# EAGLE board Resistor_Resistor (EAGLE 8.3.0), part 7 of 32
## Placement (x,y rotation side) (continued)
R7867  10K  [0201]  72.9,41.5 0 top
R7868  10K  [0201]  72.9,42.11 0 top
R7869  10K  [0201]  72.9,42.72 0 top
R7870  10K  [0201]  72.9,43.33 0 top
R7871  10K  [0201]  72.9,43.94 0 top
R7872  10K  [0201]  72.9,44.55 0 top
R7873  10K  [0201]  72.9,45.16 0 top
R7874  10K  [0201]  72.9,45.77 0 top
R7875  10K  [0201]  72.9,46.38 0 top
R7876  10K  [0201]  72.9,46.99 0 top
R7877  10K  [0201]  72.9,47.6 0 top
R7878  10K  [0201]  72.9,48.21 0 top
R7879  10K  [0201]  72.9,48.82 0 top
R7880  10K  [0201]  72.9,49.43 0 top
R7881  10K  [0201]  72.9,50.04 0 top
R7882  10K  [0201]  72.9,50.65 0 top
R7883  10K  [0201]  72.9,51.26 0 top
R7884  10K  [0201]  72.9,51.87 0 top
R7885  10K  [0201]  72.9,52.48 0 top
R7886  10K  [0201]  72.9,53.09 0 top
R7887  10K  [0201]  72.9,53.7 0 top
R7888  10K  [0201]  72.9,54.31 0 top
R7889  10K  [0201]  72.9,54.91 0 top
R7890  10K  [0201]  72.9,55.52 0 top
R7891  10K  [0201]  72.9,56.13 0 top
R7892  10K  [0201]  72.9,56.74 0 top
R7893  10K  [0201]  72.9,57.35 0 top
R7894  10K  [0201]  72.9,57.96 0 top
R7895  10K  [0201]  72.9,58.57 0 top
R7896  10K  [0201]  72.9,59.18 0 top
R7897  10K  [0201]  72.9,59.79 0 top
R7898  10K  [0201]  72.9,60.4 0 top
R7899  10K  [0201]  72.9,61.01 0 top
R7900  10K  [0201]  72.9,61.62 0 top
R7901  10K  [0201]  72.9,62.23 0 top
R7902  10K  [0201]  72.9,62.84 0 top
R7903  10K  [0201]  72.9,63.45 0 top
R7904  10K  [0201]  72.9,64.06 0 top
R7905  10K  [0201]  72.9,64.67 0 top
R7906  10K  [0201]  72.9,65.28 0 top
R7907  10K  [0201]  72.9,65.89 0 top
R7908  10K  [0201]  72.9,66.5 0 top
R7909  10K  [0201]  72.9,67.11 0 top
R7910  10K  [0201]  72.9,67.72 0 top
R7911  10K  [0201]  72.9,68.33 0 top
R7912  10K  [0201]  72.9,68.94 0 top
R7913  10K  [0201]  72.9,69.55 0 top
R7914  10K  [0201]  72.9,70.15 0 top
R7915  10K  [0201]  72.9,70.76 0 top
R7916  10K  [0201]  72.9,71.37 0 top
R7917  10K  [0201]  72.9,71.98 0 top
R7918  10K  [0201]  72.9,72.59 0 top
R7919  10K  [0201]  72.9,73.2 0 top
R7920  10K  [0201]  72.9,73.81 0 top
R7921  10K  [0201]  72.9,74.42 0 top
R7922  10K  [0201]  72.9,75.03 0 top
R7923  10K  [0201]  72.9,75.64 0 top
R7924  10K  [0201]  72.9,76.25 0 top
R7925  10K  [0201]  72.9,76.86 0 top
R7926  10K  [0201]  72.9,77.47 0 top
R7927  10K  [0201]  72.9,78.08 0 top
R7928  10K  [0201]  72.9,78.69 0 top
R7929  10K  [0201]  72.9,79.3 0 top
R7930  10K  [0201]  72.9,79.91 0 top
R7931  10K  [0201]  72.9,80.52 0 top
R7932  10K  [0201]  72.9,81.13 0 top
R7933  10K  [0201]  72.9,81.74 0 top
R7934  10K  [0201]  72.9,82.35 0 top
R7935  10K  [0201]  72.9,82.96 0 top
R7936  10K  [0201]  72.9,83.57 0 top
R7937  10K  [0201]  72.9,84.18 0 top
R7938  10K  [0201]  72.9,84.79 0 top
R7939  10K  [0201]  72.9,85.39 0 top
R7940  10K  [0201]  72.9,86 0 top
R7941  10K  [0201]  72.9,86.61 0 top
R7942  10K  [0201]  72.9,87.22 0 top
R7943  10K  [0201]  72.9,87.83 0 top
R7944  10K  [0201]  72.9,88.44 0 top
R7945  10K  [0201]  72.9,89.05 0 top
R7946  10K  [0201]  72.9,89.66 0 top
R7947  10K  [0201]  72.9,90.27 0 top
R7948  10K  [0201]  72.9,90.88 0 top
R7949  10K  [0201]  72.9,91.49 0 top
R7950  10K  [0201]  72.9,92.1 0 top
R7951  10K  [0201]  72.9,92.71 0 top
R7952  10K  [0201]  72.9,93.32 0 top
R7953  10K  [0201]  72.9,93.93 0 top
R7954  10K  [0201]  72.9,94.54 0 top
R7955  10K  [0201]  72.9,95.15 0 top
R7956  10K  [0201]  72.9,95.76 0 top
R7957  10K  [0201]  72.9,96.37 0 top
R7958  10K  [0201]  72.9,96.98 0 top
R7959  10K  [0201]  72.9,97.59 0 top
R7960  10K  [0201]  72.9,98.2 0 top
R7961  10K  [0201]  72.9,98.81 0 top
R7962  10K  [0201]  72.9,99.42 0 top
R7963  10K  [0201]  72.9,100.03 0 top
R7964  10K  [0201]  72.9,100.63 0 top
R7965  10K  [0201]  72.9,101.24 0 top
R7966  10K  [0201]  72.9,101.85 0 top
R7967  10K  [0201]  72.9,102.46 0 top
R7968  10K  [0201]  72.9,103.07 0 top
R7969  10K  [0201]  72.9,103.68 0 top
R7970  10K  [0201]  72.9,104.29 0 top
R7971  10K  [0201]  72.9,104.9 0 top
R7972  10K  [0201]  72.9,105.51 0 top
R7973  10K  [0201]  72.9,106.12 0 top
R7974  10K  [0201]  72.9,106.73 0 top
R7975  10K  [0201]  72.9,107.34 0 top
R7976  10K  [0201]  72.9,107.95 0 top
R7977  10K  [0201]  72.9,108.56 0 top
R7978  10K  [0201]  72.9,109.17 0 top
R7979  10K  [0201]  72.9,109.78 0 top
R7980  10K  [0201]  72.9,110.39 0 top
R7981  10K  [0201]  72.9,111 0 top
R7982  10K  [0201]  72.9,111.61 0 top
R7983  10K  [0201]  72.9,112.22 0 top
R7984  10K  [0201]  72.9,112.83 0 top
R7985  10K  [0201]  72.9,113.44 0 top
R7986  10K  [0201]  72.9,114.05 0 top
R7987  10K  [0201]  72.9,114.66 0 top
R7988  10K  [0201]  72.9,115.27 0 top
R7989  10K  [0201]  72.9,115.87 0 top
R7990  10K  [0201]  72.9,116.48 0 top
R7991  10K  [0201]  72.9,117.09 0 top
R7992  10K  [0201]  72.9,117.7 0 top
R7993  10K  [0201]  72.9,118.31 0 top
R7994  10K  [0201]  72.9,118.92 0 top
R7995  10K  [0201]  72.9,119.53 0 top
R7996  10K  [0201]  72.9,120.14 0 top
R7997  10K  [0201]  72.9,120.75 0 top
R7998  10K  [0201]  72.9,121.36 0 top
R7999  10K  [0201]  72.9,121.97 0 top
R8000  10K  [0201]  72.9,122.58 0 top
R8001  10K  [0201]  74.12,1.27 0 top
R8002  10K  [0201]  74.12,1.88 0 top
R8003  10K  [0201]  74.12,2.49 0 top
R8004  10K  [0201]  74.12,3.1 0 top
R8005  10K  [0201]  74.12,3.71 0 top
R8006  10K  [0201]  74.12,4.32 0 top
R8007  10K  [0201]  74.12,4.93 0 top
R8008  10K  [0201]  74.12,5.54 0 top
R8009  10K  [0201]  74.12,6.15 0 top
R8010  10K  [0201]  74.12,6.76 0 top
R8011  10K  [0201]  74.12,7.37 0 top
R8012  10K  [0201]  74.12,7.98 0 top
R8013  10K  [0201]  74.12,8.59 0 top
R8014  10K  [0201]  74.12,9.19 0 top
R8015  10K  [0201]  74.12,9.8 0 top
R8016  10K  [0201]  74.12,10.41 0 top
R8017  10K  [0201]  74.12,11.02 0 top
R8018  10K  [0201]  74.12,11.63 0 top
R8019  10K  [0201]  74.12,12.24 0 top
R8020  10K  [0201]  74.12,12.85 0 top
R8021  10K  [0201]  74.12,13.46 0 top
R8022  10K  [0201]  74.12,14.07 0 top
R8023  10K  [0201]  74.12,14.68 0 top
R8024  10K  [0201]  74.12,15.29 0 top
R8025  10K  [0201]  74.12,15.9 0 top
R8026  10K  [0201]  74.12,16.51 0 top
R8027  10K  [0201]  74.12,17.12 0 top
R8028  10K  [0201]  74.12,17.73 0 top
R8029  10K  [0201]  74.12,18.34 0 top
R8030  10K  [0201]  74.12,18.95 0 top
R8031  10K  [0201]  74.12,19.56 0 top
R8032  10K  [0201]  74.12,20.17 0 top
R8033  10K  [0201]  74.12,20.78 0 top
R8034  10K  [0201]  74.12,21.39 0 top
R8035  10K  [0201]  74.12,22 0 top
R8036  10K  [0201]  74.12,22.61 0 top
R8037  10K  [0201]  74.12,23.22 0 top
R8038  10K  [0201]  74.12,23.83 0 top
R8039  10K  [0201]  74.12,24.43 0 top
R8040  10K  [0201]  74.12,25.04 0 top
R8041  10K  [0201]  74.12,25.65 0 top
R8042  10K  [0201]  74.12,26.26 0 top
R8043  10K  [0201]  74.12,26.87 0 top
R8044  10K  [0201]  74.12,27.48 0 top
R8045  10K  [0201]  74.12,28.09 0 top
R8046  10K  [0201]  74.12,28.7 0 top
R8047  10K  [0201]  74.12,29.31 0 top
R8048  10K  [0201]  74.12,29.92 0 top
R8049  10K  [0201]  74.12,30.53 0 top
R8050  10K  [0201]  74.12,31.14 0 top
R8051  10K  [0201]  74.12,31.75 0 top
R8052  10K  [0201]  74.12,32.36 0 top
R8053  10K  [0201]  74.12,32.97 0 top
R8054  10K  [0201]  74.12,33.58 0 top
R8055  10K  [0201]  74.12,34.19 0 top
R8056  10K  [0201]  74.12,34.8 0 top
R8057  10K  [0201]  74.12,35.41 0 top
R8058  10K  [0201]  74.12,36.02 0 top
R8059  10K  [0201]  74.12,36.63 0 top
R8060  10K  [0201]  74.12,37.24 0 top
R8061  10K  [0201]  74.12,37.85 0 top
R8062  10K  [0201]  74.12,38.46 0 top
R8063  10K  [0201]  74.12,39.07 0 top
R8064  10K  [0201]  74.12,39.67 0 top
R8065  10K  [0201]  74.12,40.28 0 top
R8066  10K  [0201]  74.12,40.89 0 top
R8067  10K  [0201]  74.12,41.5 0 top
R8068  10K  [0201]  74.12,42.11 0 top
R8069  10K  [0201]  74.12,42.72 0 top
R8070  10K  [0201]  74.12,43.33 0 top
R8071  10K  [0201]  74.12,43.94 0 top
R8072  10K  [0201]  74.12,44.55 0 top
R8073  10K  [0201]  74.12,45.16 0 top
R8074  10K  [0201]  74.12,45.77 0 top
R8075  10K  [0201]  74.12,46.38 0 top
R8076  10K  [0201]  74.12,46.99 0 top
R8077  10K  [0201]  74.12,47.6 0 top
R8078  10K  [0201]  74.12,48.21 0 top
R8079  10K  [0201]  74.12,48.82 0 top
R8080  10K  [0201]  74.12,49.43 0 top
R8081  10K  [0201]  74.12,50.04 0 top
R8082  10K  [0201]  74.12,50.65 0 top
R8083  10K  [0201]  74.12,51.26 0 top
R8084  10K  [0201]  74.12,51.87 0 top
R8085  10K  [0201]  74.12,52.48 0 top
R8086  10K  [0201]  74.12,53.09 0 top
R8087  10K  [0201]  74.12,53.7 0 top
R8088  10K  [0201]  74.12,54.31 0 top
R8089  10K  [0201]  74.12,54.91 0 top
R8090  10K  [0201]  74.12,55.52 0 top
R8091  10K  [0201]  74.12,56.13 0 top
R8092  10K  [0201]  74.12,56.74 0 top
R8093  10K  [0201]  74.12,57.35 0 top
R8094  10K  [0201]  74.12,57.96 0 top
R8095  10K  [0201]  74.12,58.57 0 top
R8096  10K  [0201]  74.12,59.18 0 top
R8097  10K  [0201]  74.12,59.79 0 top
R8098  10K  [0201]  74.12,60.4 0 top
R8099  10K  [0201]  74.12,61.01 0 top
R8100  10K  [0201]  74.12,61.62 0 top
R8101  10K  [0201]  74.12,62.23 0 top
R8102  10K  [0201]  74.12,62.84 0 top
R8103  10K  [0201]  74.12,63.45 0 top
R8104  10K  [0201]  74.12,64.06 0 top
R8105  10K  [0201]  74.12,64.67 0 top
R8106  10K  [0201]  74.12,65.28 0 top
R8107  10K  [0201]  74.12,65.89 0 top
R8108  10K  [0201]  74.12,66.5 0 top
R8109  10K  [0201]  74.12,67.11 0 top
R8110  10K  [0201]  74.12,67.72 0 top
R8111  10K  [0201]  74.12,68.33 0 top
R8112  10K  [0201]  74.12,68.94 0 top
R8113  10K  [0201]  74.12,69.55 0 top
R8114  10K  [0201]  74.12,70.15 0 top
R8115  10K  [0201]  74.12,70.76 0 top
R8116  10K  [0201]  74.12,71.37 0 top
R8117  10K  [0201]  74.12,71.98 0 top
R8118  10K  [0201]  74.12,72.59 0 top
R8119  10K  [0201]  74.12,73.2 0 top
R8120  10K  [0201]  74.12,73.81 0 top
R8121  10K  [0201]  74.12,74.42 0 top
R8122  10K  [0201]  74.12,75.03 0 top
R8123  10K  [0201]  74.12,75.64 0 top
R8124  10K  [0201]  74.12,76.25 0 top
R8125  10K  [0201]  74.12,76.86 0 top
R8126  10K  [0201]  74.12,77.47 0 top
R8127  10K  [0201]  74.12,78.08 0 top
R8128  10K  [0201]  74.12,78.69 0 top
R8129  10K  [0201]  74.12,79.3 0 top
R8130  10K  [0201]  74.12,79.91 0 top
R8131  10K  [0201]  74.12,80.52 0 top
R8132  10K  [0201]  74.12,81.13 0 top
R8133  10K  [0201]  74.12,81.74 0 top
R8134  10K  [0201]  74.12,82.35 0 top
R8135  10K  [0201]  74.12,82.96 0 top
R8136  10K  [0201]  74.12,83.57 0 top
R8137  10K  [0201]  74.12,84.18 0 top
R8138  10K  [0201]  74.12,84.79 0 top
R8139  10K  [0201]  74.12,85.39 0 top
R8140  10K  [0201]  74.12,86 0 top
R8141  10K  [0201]  74.12,86.61 0 top
R8142  10K  [0201]  74.12,87.22 0 top
R8143  10K  [0201]  74.12,87.83 0 top
R8144  10K  [0201]  74.12,88.44 0 top
R8145  10K  [0201]  74.12,89.05 0 top
R8146  10K  [0201]  74.12,89.66 0 top
R8147  10K  [0201]  74.12,90.27 0 top
R8148  10K  [0201]  74.12,90.88 0 top
R8149  10K  [0201]  74.12,91.49 0 top
R8150  10K  [0201]  74.12,92.1 0 top
R8151  10K  [0201]  74.12,92.71 0 top
R8152  10K  [0201]  74.12,93.32 0 top
R8153  10K  [0201]  74.12,93.93 0 top
R8154  10K  [0201]  74.12,94.54 0 top
R8155  10K  [0201]  74.12,95.15 0 top
R8156  10K  [0201]  74.12,95.76 0 top
R8157  10K  [0201]  74.12,96.37 0 top
R8158  10K  [0201]  74.12,96.98 0 top
R8159  10K  [0201]  74.12,97.59 0 top
R8160  10K  [0201]  74.12,98.2 0 top
R8161  10K  [0201]  74.12,98.81 0 top
R8162  10K  [0201]  74.12,99.42 0 top
R8163  10K  [0201]  74.12,100.03 0 top
R8164  10K  [0201]  74.12,100.63 0 top
R8165  10K  [0201]  74.12,101.24 0 top
R8166  10K  [0201]  74.12,101.85 0 top
R8167  10K  [0201]  74.12,102.46 0 top
R8168  10K  [0201]  74.12,103.07 0 top
R8169  10K  [0201]  74.12,103.68 0 top
R8170  10K  [0201]  74.12,104.29 0 top
R8171  10K  [0201]  74.12,104.9 0 top
R8172  10K  [0201]  74.12,105.51 0 top
R8173  10K  [0201]  74.12,106.12 0 top
R8174  10K  [0201]  74.12,106.73 0 top
R8175  10K  [0201]  74.12,107.34 0 top
R8176  10K  [0201]  74.12,107.95 0 top
R8177  10K  [0201]  74.12,108.56 0 top
R8178  10K  [0201]  74.12,109.17 0 top
R8179  10K  [0201]  74.12,109.78 0 top
R8180  10K  [0201]  74.12,110.39 0 top
R8181  10K  [0201]  74.12,111 0 top
R8182  10K  [0201]  74.12,111.61 0 top
R8183  10K  [0201]  74.12,112.22 0 top
R8184  10K  [0201]  74.12,112.83 0 top
R8185  10K  [0201]  74.12,113.44 0 top
R8186  10K  [0201]  74.12,114.05 0 top
R8187  10K  [0201]  74.12,114.66 0 top
R8188  10K  [0201]  74.12,115.27 0 top
R8189  10K  [0201]  74.12,115.87 0 top
R8190  10K  [0201]  74.12,116.48 0 top
R8191  10K  [0201]  74.12,117.09 0 top
R8192  10K  [0201]  74.12,117.7 0 top
R8193  10K  [0201]  74.12,118.31 0 top
R8194  10K  [0201]  74.12,118.92 0 top
R8195  10K  [0201]  74.12,119.53 0 top
R8196  10K  [0201]  74.12,120.14 0 top
R8197  10K  [0201]  74.12,120.75 0 top
R8198  10K  [0201]  74.12,121.36 0 top
R8199  10K  [0201]  74.12,121.97 0 top
R8200  10K  [0201]  74.12,122.58 0 top
R8201  10K  [0201]  75.34,1.27 0 top
R8202  10K  [0201]  75.34,1.88 0 top
R8203  10K  [0201]  75.34,2.49 0 top
R8204  10K  [0201]  75.34,3.1 0 top
R8205  10K  [0201]  75.34,3.71 0 top
R8206  10K  [0201]  75.34,4.32 0 top
R8207  10K  [0201]  75.34,4.93 0 top
R8208  10K  [0201]  75.34,5.54 0 top
R8209  10K  [0201]  75.34,6.15 0 top
R8210  10K  [0201]  75.34,6.76 0 top
R8211  10K  [0201]  75.34,7.37 0 top
R8212  10K  [0201]  75.34,7.98 0 top
R8213  10K  [0201]  75.34,8.59 0 top
R8214  10K  [0201]  75.34,9.19 0 top
R8215  10K  [0201]  75.34,9.8 0 top
R8216  10K  [0201]  75.34,10.41 0 top
R8217  10K  [0201]  75.34,11.02 0 top
R8218  10K  [0201]  75.34,11.63 0 top
R8219  10K  [0201]  75.34,12.24 0 top
R8220  10K  [0201]  75.34,12.85 0 top
R8221  10K  [0201]  75.34,13.46 0 top
R8222  10K  [0201]  75.34,14.07 0 top
R8223  10K  [0201]  75.34,14.68 0 top
R8224  10K  [0201]  75.34,15.29 0 top
R8225  10K  [0201]  75.34,15.9 0 top
R8226  10K  [0201]  75.34,16.51 0 top
R8227  10K  [0201]  75.34,17.12 0 top
R8228  10K  [0201]  75.34,17.73 0 top
R8229  10K  [0201]  75.34,18.34 0 top
R8230  10K  [0201]  75.34,18.95 0 top
R8231  10K  [0201]  75.34,19.56 0 top
R8232  10K  [0201]  75.34,20.17 0 top
R8233  10K  [0201]  75.34,20.78 0 top
R8234  10K  [0201]  75.34,21.39 0 top
R8235  10K  [0201]  75.34,22 0 top
R8236  10K  [0201]  75.34,22.61 0 top
R8237  10K  [0201]  75.34,23.22 0 top
R8238  10K  [0201]  75.34,23.83 0 top
R8239  10K  [0201]  75.34,24.43 0 top
R8240  10K  [0201]  75.34,25.04 0 top
R8241  10K  [0201]  75.34,25.65 0 top
R8242  10K  [0201]  75.34,26.26 0 top
R8243  10K  [0201]  75.34,26.87 0 top
R8244  10K  [0201]  75.34,27.48 0 top
R8245  10K  [0201]  75.34,28.09 0 top
R8246  10K  [0201]  75.34,28.7 0 top
R8247  10K  [0201]  75.34,29.31 0 top
R8248  10K  [0201]  75.34,29.92 0 top
R8249  10K  [0201]  75.34,30.53 0 top
R8250  10K  [0201]  75.34,31.14 0 top
R8251  10K  [0201]  75.34,31.75 0 top
R8252  10K  [0201]  75.34,32.36 0 top
R8253  10K  [0201]  75.34,32.97 0 top
R8254  10K  [0201]  75.34,33.58 0 top
R8255  10K  [0201]  75.34,34.19 0 top
R8256  10K  [0201]  75.34,34.8 0 top
R8257  10K  [0201]  75.34,35.41 0 top
R8258  10K  [0201]  75.34,36.02 0 top
R8259  10K  [0201]  75.34,36.63 0 top
R8260  10K  [0201]  75.34,37.24 0 top
R8261  10K  [0201]  75.34,37.85 0 top
R8262  10K  [0201]  75.34,38.46 0 top
R8263  10K  [0201]  75.34,39.07 0 top
R8264  10K  [0201]  75.34,39.67 0 top
R8265  10K  [0201]  75.34,40.28 0 top
R8266  10K  [0201]  75.34,40.89 0 top
R8267  10K  [0201]  75.34,41.5 0 top
R8268  10K  [0201]  75.34,42.11 0 top
R8269  10K  [0201]  75.34,42.72 0 top
R8270  10K  [0201]  75.34,43.33 0 top
R8271  10K  [0201]  75.34,43.94 0 top
R8272  10K  [0201]  75.34,44.55 0 top
R8273  10K  [0201]  75.34,45.16 0 top
R8274  10K  [0201]  75.34,45.77 0 top
R8275  10K  [0201]  75.34,46.38 0 top
R8276  10K  [0201]  75.34,46.99 0 top
R8277  10K  [0201]  75.34,47.6 0 top
R8278  10K  [0201]  75.34,48.21 0 top
R8279  10K  [0201]  75.34,48.82 0 top
R8280  10K  [0201]  75.34,49.43 0 top
R8281  10K  [0201]  75.34,50.04 0 top
R8282  10K  [0201]  75.34,50.65 0 top
R8283  10K  [0201]  75.34,51.26 0 top
R8284  10K  [0201]  75.34,51.87 0 top
R8285  10K  [0201]  75.34,52.48 0 top
R8286  10K  [0201]  75.34,53.09 0 top
R8287  10K  [0201]  75.34,53.7 0 top
R8288  10K  [0201]  75.34,54.31 0 top
R8289  10K  [0201]  75.34,54.91 0 top
R8290  10K  [0201]  75.34,55.52 0 top
R8291  10K  [0201]  75.34,56.13 0 top
R8292  10K  [0201]  75.34,56.74 0 top
R8293  10K  [0201]  75.34,57.35 0 top
R8294  10K  [0201]  75.34,57.96 0 top
R8295  10K  [0201]  75.34,58.57 0 top
R8296  10K  [0201]  75.34,59.18 0 top
R8297  10K  [0201]  75.34,59.79 0 top
R8298  10K  [0201]  75.34,60.4 0 top
R8299  10K  [0201]  75.34,61.01 0 top
R8300  10K  [0201]  75.34,61.62 0 top
R8301  10K  [0201]  75.34,62.23 0 top
R8302  10K  [0201]  75.34,62.84 0 top
R8303  10K  [0201]  75.34,63.45 0 top
R8304  10K  [0201]  75.34,64.06 0 top
R8305  10K  [0201]  75.34,64.67 0 top
R8306  10K  [0201]  75.34,65.28 0 top
R8307  10K  [0201]  75.34,65.89 0 top
R8308  10K  [0201]  75.34,66.5 0 top
R8309  10K  [0201]  75.34,67.11 0 top
R8310  10K  [0201]  75.34,67.72 0 top
R8311  10K  [0201]  75.34,68.33 0 top
R8312  10K  [0201]  75.34,68.94 0 top
R8313  10K  [0201]  75.34,69.55 0 top
R8314  10K  [0201]  75.34,70.15 0 top
R8315  10K  [0201]  75.34,70.76 0 top
R8316  10K  [0201]  75.34,71.37 0 top
R8317  10K  [0201]  75.34,71.98 0 top
R8318  10K  [0201]  75.34,72.59 0 top
R8319  10K  [0201]  75.34,73.2 0 top
R8320  10K  [0201]  75.34,73.81 0 top
R8321  10K  [0201]  75.34,74.42 0 top
R8322  10K  [0201]  75.34,75.03 0 top
R8323  10K  [0201]  75.34,75.64 0 top
R8324  10K  [0201]  75.34,76.25 0 top
R8325  10K  [0201]  75.34,76.86 0 top
R8326  10K  [0201]  75.34,77.47 0 top
R8327  10K  [0201]  75.34,78.08 0 top
R8328  10K  [0201]  75.34,78.69 0 top
R8329  10K  [0201]  75.34,79.3 0 top
R8330  10K  [0201]  75.34,79.91 0 top
R8331  10K  [0201]  75.34,80.52 0 top
R8332  10K  [0201]  75.34,81.13 0 top
R8333  10K  [0201]  75.34,81.74 0 top
R8334  10K  [0201]  75.34,82.35 0 top
R8335  10K  [0201]  75.34,82.96 0 top
R8336  10K  [0201]  75.34,83.57 0 top
R8337  10K  [0201]  75.34,84.18 0 top
R8338  10K  [0201]  75.34,84.79 0 top
R8339  10K  [0201]  75.34,85.39 0 top
R8340  10K  [0201]  75.34,86 0 top
R8341  10K  [0201]  75.34,86.61 0 top
R8342  10K  [0201]  75.34,87.22 0 top
R8343  10K  [0201]  75.34,87.83 0 top
R8344  10K  [0201]  75.34,88.44 0 top
R8345  10K  [0201]  75.34,89.05 0 top
R8346  10K  [0201]  75.34,89.66 0 top
R8347  10K  [0201]  75.34,90.27 0 top
R8348  10K  [0201]  75.34,90.88 0 top
R8349  10K  [0201]  75.34,91.49 0 top
R8350  10K  [0201]  75.34,92.1 0 top
R8351  10K  [0201]  75.34,92.71 0 top
R8352  10K  [0201]  75.34,93.32 0 top
R8353  10K  [0201]  75.34,93.93 0 top
R8354  10K  [0201]  75.34,94.54 0 top
R8355  10K  [0201]  75.34,95.15 0 top
R8356  10K  [0201]  75.34,95.76 0 top
R8357  10K  [0201]  75.34,96.37 0 top
R8358  10K  [0201]  75.34,96.98 0 top
R8359  10K  [0201]  75.34,97.59 0 top
R8360  10K  [0201]  75.34,98.2 0 top
R8361  10K  [0201]  75.34,98.81 0 top
R8362  10K  [0201]  75.34,99.42 0 top
R8363  10K  [0201]  75.34,100.03 0 top
R8364  10K  [0201]  75.34,100.63 0 top
R8365  10K  [0201]  75.34,101.24 0 top
R8366  10K  [0201]  75.34,101.85 0 top
R8367  10K  [0201]  75.34,102.46 0 top
R8368  10K  [0201]  75.34,103.07 0 top
R8369  10K  [0201]  75.34,103.68 0 top
R8370  10K  [0201]  75.34,104.29 0 top
R8371  10K  [0201]  75.34,104.9 0 top
R8372  10K  [0201]  75.34,105.51 0 top
R8373  10K  [0201]  75.34,106.12 0 top
R8374  10K  [0201]  75.34,106.73 0 top
R8375  10K  [0201]  75.34,107.34 0 top
R8376  10K  [0201]  75.34,107.95 0 top
R8377  10K  [0201]  75.34,108.56 0 top
R8378  10K  [0201]  75.34,109.17 0 top
R8379  10K  [0201]  75.34,109.78 0 top
R8380  10K  [0201]  75.34,110.39 0 top
R8381  10K  [0201]  75.34,111 0 top
R8382  10K  [0201]  75.34,111.61 0 top
R8383  10K  [0201]  75.34,112.22 0 top
R8384  10K  [0201]  75.34,112.83 0 top
R8385  10K  [0201]  75.34,113.44 0 top
R8386  10K  [0201]  75.34,114.05 0 top
R8387  10K  [0201]  75.34,114.66 0 top
R8388  10K  [0201]  75.34,115.27 0 top
R8389  10K  [0201]  75.34,115.87 0 top
R8390  10K  [0201]  75.34,116.48 0 top
R8391  10K  [0201]  75.34,117.09 0 top
R8392  10K  [0201]  75.34,117.7 0 top
R8393  10K  [0201]  75.34,118.31 0 top
R8394  10K  [0201]  75.34,118.92 0 top
R8395  10K  [0201]  75.34,119.53 0 top
R8396  10K  [0201]  75.34,120.14 0 top
R8397  10K  [0201]  75.34,120.75 0 top
R8398  10K  [0201]  75.34,121.36 0 top
R8399  10K  [0201]  75.34,121.97 0 top
R8400  10K  [0201]  75.34,122.58 0 top
R8401  10K  [0201]  76.56,1.27 0 top
R8402  10K  [0201]  76.56,1.88 0 top
R8403  10K  [0201]  76.56,2.49 0 top
R8404  10K  [0201]  76.56,3.1 0 top
R8405  10K  [0201]  76.56,3.71 0 top
R8406  10K  [0201]  76.56,4.32 0 top
R8407  10K  [0201]  76.56,4.93 0 top
R8408  10K  [0201]  76.56,5.54 0 top
R8409  10K  [0201]  76.56,6.15 0 top
R8410  10K  [0201]  76.56,6.76 0 top
R8411  10K  [0201]  76.56,7.37 0 top
R8412  10K  [0201]  76.56,7.98 0 top
R8413  10K  [0201]  76.56,8.59 0 top
R8414  10K  [0201]  76.56,9.19 0 top
R8415  10K  [0201]  76.56,9.8 0 top
R8416  10K  [0201]  76.56,10.41 0 top
R8417  10K  [0201]  76.56,11.02 0 top
R8418  10K  [0201]  76.56,11.63 0 top
R8419  10K  [0201]  76.56,12.24 0 top
R8420  10K  [0201]  76.56,12.85 0 top
R8421  10K  [0201]  76.56,13.46 0 top
R8422  10K  [0201]  76.56,14.07 0 top
R8423  10K  [0201]  76.56,14.68 0 top
R8424  10K  [0201]  76.56,15.29 0 top
R8425  10K  [0201]  76.56,15.9 0 top
R8426  10K  [0201]  76.56,16.51 0 top
R8427  10K  [0201]  76.56,17.12 0 top
R8428  10K  [0201]  76.56,17.73 0 top
R8429  10K  [0201]  76.56,18.34 0 top
R8430  10K  [0201]  76.56,18.95 0 top
R8431  10K  [0201]  76.56,19.56 0 top
R8432  10K  [0201]  76.56,20.17 0 top
R8433  10K  [0201]  76.56,20.78 0 top
R8434  10K  [0201]  76.56,21.39 0 top
R8435  10K  [0201]  76.56,22 0 top
R8436  10K  [0201]  76.56,22.61 0 top
R8437  10K  [0201]  76.56,23.22 0 top
R8438  10K  [0201]  76.56,23.83 0 top
R8439  10K  [0201]  76.56,24.43 0 top
R8440  10K  [0201]  76.56,25.04 0 top
R8441  10K  [0201]  76.56,25.65 0 top
R8442  10K  [0201]  76.56,26.26 0 top
R8443  10K  [0201]  76.56,26.87 0 top
R8444  10K  [0201]  76.56,27.48 0 top
R8445  10K  [0201]  76.56,28.09 0 top
R8446  10K  [0201]  76.56,28.7 0 top
R8447  10K  [0201]  76.56,29.31 0 top
R8448  10K  [0201]  76.56,29.92 0 top
R8449  10K  [0201]  76.56,30.53 0 top
R8450  10K  [0201]  76.56,31.14 0 top
R8451  10K  [0201]  76.56,31.75 0 top
R8452  10K  [0201]  76.56,32.36 0 top
R8453  10K  [0201]  76.56,32.97 0 top
R8454  10K  [0201]  76.56,33.58 0 top
R8455  10K  [0201]  76.56,34.19 0 top
R8456  10K  [0201]  76.56,34.8 0 top
R8457  10K  [0201]  76.56,35.41 0 top
R8458  10K  [0201]  76.56,36.02 0 top
R8459  10K  [0201]  76.56,36.63 0 top
R8460  10K  [0201]  76.56,37.24 0 top
R8461  10K  [0201]  76.56,37.85 0 top
R8462  10K  [0201]  76.56,38.46 0 top
R8463  10K  [0201]  76.56,39.07 0 top
R8464  10K  [0201]  76.56,39.67 0 top
R8465  10K  [0201]  76.56,40.28 0 top
R8466  10K  [0201]  76.56,40.89 0 top
R8467  10K  [0201]  76.56,41.5 0 top
R8468  10K  [0201]  76.56,42.11 0 top
R8469  10K  [0201]  76.56,42.72 0 top
R8470  10K  [0201]  76.56,43.33 0 top
R8471  10K  [0201]  76.56,43.94 0 top
R8472  10K  [0201]  76.56,44.55 0 top
R8473  10K  [0201]  76.56,45.16 0 top
R8474  10K  [0201]  76.56,45.77 0 top
R8475  10K  [0201]  76.56,46.38 0 top
R8476  10K  [0201]  76.56,46.99 0 top
R8477  10K  [0201]  76.56,47.6 0 top
R8478  10K  [0201]  76.56,48.21 0 top
R8479  10K  [0201]  76.56,48.82 0 top
R8480  10K  [0201]  76.56,49.43 0 top
R8481  10K  [0201]  76.56,50.04 0 top
R8482  10K  [0201]  76.56,50.65 0 top
R8483  10K  [0201]  76.56,51.26 0 top
R8484  10K  [0201]  76.56,51.87 0 top
R8485  10K  [0201]  76.56,52.48 0 top
R8486  10K  [0201]  76.56,53.09 0 top
R8487  10K  [0201]  76.56,53.7 0 top
R8488  10K  [0201]  76.56,54.31 0 top
R8489  10K  [0201]  76.56,54.91 0 top
R8490  10K  [0201]  76.56,55.52 0 top
R8491  10K  [0201]  76.56,56.13 0 top
R8492  10K  [0201]  76.56,56.74 0 top
R8493  10K  [0201]  76.56,57.35 0 top
R8494  10K  [0201]  76.56,57.96 0 top
R8495  10K  [0201]  76.56,58.57 0 top
R8496  10K  [0201]  76.56,59.18 0 top
R8497  10K  [0201]  76.56,59.79 0 top
R8498  10K  [0201]  76.56,60.4 0 top
R8499  10K  [0201]  76.56,61.01 0 top
R8500  10K  [0201]  76.56,61.62 0 top
R8501  10K  [0201]  76.56,62.23 0 top
R8502  10K  [0201]  76.56,62.84 0 top
R8503  10K  [0201]  76.56,63.45 0 top
R8504  10K  [0201]  76.56,64.06 0 top
R8505  10K  [0201]  76.56,64.67 0 top
R8506  10K  [0201]  76.56,65.28 0 top
R8507  10K  [0201]  76.56,65.89 0 top
R8508  10K  [0201]  76.56,66.5 0 top
R8509  10K  [0201]  76.56,67.11 0 top
R8510  10K  [0201]  76.56,67.72 0 top
R8511  10K  [0201]  76.56,68.33 0 top
R8512  10K  [0201]  76.56,68.94 0 top
R8513  10K  [0201]  76.56,69.55 0 top
R8514  10K  [0201]  76.56,70.15 0 top
R8515  10K  [0201]  76.56,70.76 0 top
R8516  10K  [0201]  76.56,71.37 0 top
R8517  10K  [0201]  76.56,71.98 0 top
R8518  10K  [0201]  76.56,72.59 0 top
R8519  10K  [0201]  76.56,73.2 0 top
R8520  10K  [0201]  76.56,73.81 0 top
R8521  10K  [0201]  76.56,74.42 0 top
R8522  10K  [0201]  76.56,75.03 0 top
R8523  10K  [0201]  76.56,75.64 0 top
R8524  10K  [0201]  76.56,76.25 0 top
R8525  10K  [0201]  76.56,76.86 0 top
R8526  10K  [0201]  76.56,77.47 0 top
R8527  10K  [0201]  76.56,78.08 0 top
R8528  10K  [0201]  76.56,78.69 0 top
R8529  10K  [0201]  76.56,79.3 0 top
R8530  10K  [0201]  76.56,79.91 0 top
R8531  10K  [0201]  76.56,80.52 0 top
R8532  10K  [0201]  76.56,81.13 0 top
R8533  10K  [0201]  76.56,81.74 0 top
R8534  10K  [0201]  76.56,82.35 0 top
R8535  10K  [0201]  76.56,82.96 0 top
R8536  10K  [0201]  76.56,83.57 0 top
R8537  10K  [0201]  76.56,84.18 0 top
R8538  10K  [0201]  76.56,84.79 0 top
R8539  10K  [0201]  76.56,85.39 0 top
R8540  10K  [0201]  76.56,86 0 top
R8541  10K  [0201]  76.56,86.61 0 top
R8542  10K  [0201]  76.56,87.22 0 top
R8543  10K  [0201]  76.56,87.83 0 top
R8544  10K  [0201]  76.56,88.44 0 top
R8545  10K  [0201]  76.56,89.05 0 top
R8546  10K  [0201]  76.56,89.66 0 top
R8547  10K  [0201]  76.56,90.27 0 top
R8548  10K  [0201]  76.56,90.88 0 top
R8549  10K  [0201]  76.56,91.49 0 top
R8550  10K  [0201]  76.56,92.1 0 top
R8551  10K  [0201]  76.56,92.71 0 top
R8552  10K  [0201]  76.56,93.32 0 top
R8553  10K  [0201]  76.56,93.93 0 top
R8554  10K  [0201]  76.56,94.54 0 top
R8555  10K  [0201]  76.56,95.15 0 top
R8556  10K  [0201]  76.56,95.76 0 top
R8557  10K  [0201]  76.56,96.37 0 top
R8558  10K  [0201]  76.56,96.98 0 top
R8559  10K  [0201]  76.56,97.59 0 top
R8560  10K  [0201]  76.56,98.2 0 top
R8561  10K  [0201]  76.56,98.81 0 top
R8562  10K  [0201]  76.56,99.42 0 top
R8563  10K  [0201]  76.56,100.03 0 top
R8564  10K  [0201]  76.56,100.63 0 top
R8565  10K  [0201]  76.56,101.24 0 top
R8566  10K  [0201]  76.56,101.85 0 top
R8567  10K  [0201]  76.56,102.46 0 top
R8568  10K  [0201]  76.56,103.07 0 top
R8569  10K  [0201]  76.56,103.68 0 top
R8570  10K  [0201]  76.56,104.29 0 top
R8571  10K  [0201]  76.56,104.9 0 top
R8572  10K  [0201]  76.56,105.51 0 top
R8573  10K  [0201]  76.56,106.12 0 top
R8574  10K  [0201]  76.56,106.73 0 top
R8575  10K  [0201]  76.56,107.34 0 top
R8576  10K  [0201]  76.56,107.95 0 top
R8577  10K  [0201]  76.56,108.56 0 top
R8578  10K  [0201]  76.56,109.17 0 top
R8579  10K  [0201]  76.56,109.78 0 top
R8580  10K  [0201]  76.56,110.39 0 top
R8581  10K  [0201]  76.56,111 0 top
R8582  10K  [0201]  76.56,111.61 0 top
R8583  10K  [0201]  76.56,112.22 0 top
R8584  10K  [0201]  76.56,112.83 0 top
R8585  10K  [0201]  76.56,113.44 0 top
R8586  10K  [0201]  76.56,114.05 0 top
R8587  10K  [0201]  76.56,114.66 0 top
R8588  10K  [0201]  76.56,115.27 0 top
R8589  10K  [0201]  76.56,115.87 0 top
R8590  10K  [0201]  76.56,116.48 0 top
R8591  10K  [0201]  76.56,117.09 0 top
R8592  10K  [0201]  76.56,117.7 0 top
R8593  10K  [0201]  76.56,118.31 0 top
R8594  10K  [0201]  76.56,118.92 0 top
R8595  10K  [0201]  76.56,119.53 0 top
R8596  10K  [0201]  76.56,120.14 0 top
R8597  10K  [0201]  76.56,120.75 0 top
R8598  10K  [0201]  76.56,121.36 0 top
R8599  10K  [0201]  76.56,121.97 0 top
R8600  10K  [0201]  76.56,122.58 0 top
R8601  10K  [0201]  77.77,1.27 0 top
R8602  10K  [0201]  77.77,1.88 0 top
R8603  10K  [0201]  77.77,2.49 0 top
R8604  10K  [0201]  77.77,3.1 0 top
R8605  10K  [0201]  77.77,3.71 0 top
R8606  10K  [0201]  77.77,4.32 0 top
R8607  10K  [0201]  77.77,4.93 0 top
R8608  10K  [0201]  77.77,5.54 0 top
R8609  10K  [0201]  77.77,6.15 0 top
R8610  10K  [0201]  77.77,6.76 0 top
R8611  10K  [0201]  77.77,7.37 0 top
R8612  10K  [0201]  77.77,7.98 0 top
R8613  10K  [0201]  77.77,8.59 0 top
R8614  10K  [0201]  77.77,9.19 0 top
R8615  10K  [0201]  77.77,9.8 0 top
R8616  10K  [0201]  77.77,10.41 0 top
R8617  10K  [0201]  77.77,11.02 0 top
R8618  10K  [0201]  77.77,11.63 0 top
R8619  10K  [0201]  77.77,12.24 0 top
R8620  10K  [0201]  77.77,12.85 0 top
R8621  10K  [0201]  77.77,13.46 0 top
R8622  10K  [0201]  77.77,14.07 0 top
R8623  10K  [0201]  77.77,14.68 0 top
R8624  10K  [0201]  77.77,15.29 0 top
R8625  10K  [0201]  77.77,15.9 0 top
R8626  10K  [0201]  77.77,16.51 0 top
R8627  10K  [0201]  77.77,17.12 0 top
R8628  10K  [0201]  77.77,17.73 0 top
R8629  10K  [0201]  77.77,18.34 0 top
R8630  10K  [0201]  77.77,18.95 0 top
R8631  10K  [0201]  77.77,19.56 0 top
R8632  10K  [0201]  77.77,20.17 0 top
R8633  10K  [0201]  77.77,20.78 0 top
R8634  10K  [0201]  77.77,21.39 0 top
R8635  10K  [0201]  77.77,22 0 top
R8636  10K  [0201]  77.77,22.61 0 top
R8637  10K  [0201]  77.77,23.22 0 top
R8638  10K  [0201]  77.77,23.83 0 top
R8639  10K  [0201]  77.77,24.43 0 top
R8640  10K  [0201]  77.77,25.04 0 top
R8641  10K  [0201]  77.77,25.65 0 top
R8642  10K  [0201]  77.77,26.26 0 top
R8643  10K  [0201]  77.77,26.87 0 top
R8644  10K  [0201]  77.77,27.48 0 top
R8645  10K  [0201]  77.77,28.09 0 top
R8646  10K  [0201]  77.77,28.7 0 top
R8647  10K  [0201]  77.77,29.31 0 top
R8648  10K  [0201]  77.77,29.92 0 top
R8649  10K  [0201]  77.77,30.53 0 top
R8650  10K  [0201]  77.77,31.14 0 top
R8651  10K  [0201]  77.77,31.75 0 top
R8652  10K  [0201]  77.77,32.36 0 top
R8653  10K  [0201]  77.77,32.97 0 top
R8654  10K  [0201]  77.77,33.58 0 top
R8655  10K  [0201]  77.77,34.19 0 top
R8656  10K  [0201]  77.77,34.8 0 top
R8657  10K  [0201]  77.77,35.41 0 top
R8658  10K  [0201]  77.77,36.02 0 top
R8659  10K  [0201]  77.77,36.63 0 top
R8660  10K  [0201]  77.77,37.24 0 top
R8661  10K  [0201]  77.77,37.85 0 top
R8662  10K  [0201]  77.77,38.46 0 top
R8663  10K  [0201]  77.77,39.07 0 top
R8664  10K  [0201]  77.77,39.67 0 top
R8665  10K  [0201]  77.77,40.28 0 top
R8666  10K  [0201]  77.77,40.89 0 top
R8667  10K  [0201]  77.77,41.5 0 top
R8668  10K  [0201]  77.77,42.11 0 top
R8669  10K  [0201]  77.77,42.72 0 top
R8670  10K  [0201]  77.77,43.33 0 top
R8671  10K  [0201]  77.77,43.94 0 top
R8672  10K  [0201]  77.77,44.55 0 top
R8673  10K  [0201]  77.77,45.16 0 top
R8674  10K  [0201]  77.77,45.77 0 top
R8675  10K  [0201]  77.77,46.38 0 top
R8676  10K  [0201]  77.77,46.99 0 top
R8677  10K  [0201]  77.77,47.6 0 top
R8678  10K  [0201]  77.77,48.21 0 top
R8679  10K  [0201]  77.77,48.82 0 top
R8680  10K  [0201]  77.77,49.43 0 top
R8681  10K  [0201]  77.77,50.04 0 top
R8682  10K  [0201]  77.77,50.65 0 top
R8683  10K  [0201]  77.77,51.26 0 top
R8684  10K  [0201]  77.77,51.87 0 top
R8685  10K  [0201]  77.77,52.48 0 top
R8686  10K  [0201]  77.77,53.09 0 top
R8687  10K  [0201]  77.77,53.7 0 top
R8688  10K  [0201]  77.77,54.31 0 top
R8689  10K  [0201]  77.77,54.91 0 top
R8690  10K  [0201]  77.77,55.52 0 top
R8691  10K  [0201]  77.77,56.13 0 top
R8692  10K  [0201]  77.77,56.74 0 top
R8693  10K  [0201]  77.77,57.35 0 top
R8694  10K  [0201]  77.77,57.96 0 top
R8695  10K  [0201]  77.77,58.57 0 top
R8696  10K  [0201]  77.77,59.18 0 top
R8697  10K  [0201]  77.77,59.79 0 top
R8698  10K  [0201]  77.77,60.4 0 top
R8699  10K  [0201]  77.77,61.01 0 top
R8700  10K  [0201]  77.77,61.62 0 top
R8701  10K  [0201]  77.77,62.23 0 top
R8702  10K  [0201]  77.77,62.84 0 top
R8703  10K  [0201]  77.77,63.45 0 top
R8704  10K  [0201]  77.77,64.06 0 top
R8705  10K  [0201]  77.77,64.67 0 top
R8706  10K  [0201]  77.77,65.28 0 top
R8707  10K  [0201]  77.77,65.89 0 top
R8708  10K  [0201]  77.77,66.5 0 top
R8709  10K  [0201]  77.77,67.11 0 top
R8710  10K  [0201]  77.77,67.72 0 top
R8711  10K  [0201]  77.77,68.33 0 top
R8712  10K  [0201]  77.77,68.94 0 top
R8713  10K  [0201]  77.77,69.55 0 top
R8714  10K  [0201]  77.77,70.15 0 top
R8715  10K  [0201]  77.77,70.76 0 top
R8716  10K  [0201]  77.77,71.37 0 top
R8717  10K  [0201]  77.77,71.98 0 top
R8718  10K  [0201]  77.77,72.59 0 top
R8719  10K  [0201]  77.77,73.2 0 top
R8720  10K  [0201]  77.77,73.81 0 top
R8721  10K  [0201]  77.77,74.42 0 top
R8722  10K  [0201]  77.77,75.03 0 top
R8723  10K  [0201]  77.77,75.64 0 top
R8724  10K  [0201]  77.77,76.25 0 top
R8725  10K  [0201]  77.77,76.86 0 top
R8726  10K  [0201]  77.77,77.47 0 top
R8727  10K  [0201]  77.77,78.08 0 top
R8728  10K  [0201]  77.77,78.69 0 top
R8729  10K  [0201]  77.77,79.3 0 top
R8730  10K  [0201]  77.77,79.91 0 top
R8731  10K  [0201]  77.77,80.52 0 top
R8732  10K  [0201]  77.77,81.13 0 top
R8733  10K  [0201]  77.77,81.74 0 top
R8734  10K  [0201]  77.77,82.35 0 top
R8735  10K  [0201]  77.77,82.96 0 top
R8736  10K  [0201]  77.77,83.57 0 top
R8737  10K  [0201]  77.77,84.18 0 top
R8738  10K  [0201]  77.77,84.79 0 top
R8739  10K  [0201]  77.77,85.39 0 top
R8740  10K  [0201]  77.77,86 0 top
R8741  10K  [0201]  77.77,86.61 0 top
R8742  10K  [0201]  77.77,87.22 0 top
R8743  10K  [0201]  77.77,87.83 0 top
R8744  10K  [0201]  77.77,88.44 0 top
R8745  10K  [0201]  77.77,89.05 0 top
R8746  10K  [0201]  77.77,89.66 0 top
R8747  10K  [0201]  77.77,90.27 0 top
R8748  10K  [0201]  77.77,90.88 0 top
R8749  10K  [0201]  77.77,91.49 0 top
R8750  10K  [0201]  77.77,92.1 0 top
R8751  10K  [0201]  77.77,92.71 0 top
R8752  10K  [0201]  77.77,93.32 0 top
R8753  10K  [0201]  77.77,93.93 0 top
R8754  10K  [0201]  77.77,94.54 0 top
R8755  10K  [0201]  77.77,95.15 0 top
R8756  10K  [0201]  77.77,95.76 0 top
R8757  10K  [0201]  77.77,96.37 0 top
R8758  10K  [0201]  77.77,96.98 0 top
R8759  10K  [0201]  77.77,97.59 0 top
R8760  10K  [0201]  77.77,98.2 0 top
R8761  10K  [0201]  77.77,98.81 0 top
R8762  10K  [0201]  77.77,99.42 0 top
R8763  10K  [0201]  77.77,100.03 0 top
R8764  10K  [0201]  77.77,100.63 0 top
R8765  10K  [0201]  77.77,101.24 0 top
R8766  10K  [0201]  77.77,101.85 0 top
R8767  10K  [0201]  77.77,102.46 0 top
R8768  10K  [0201]  77.77,103.07 0 top
R8769  10K  [0201]  77.77,103.68 0 top
R8770  10K  [0201]  77.77,104.29 0 top
R8771  10K  [0201]  77.77,104.9 0 top
R8772  10K  [0201]  77.77,105.51 0 top
R8773  10K  [0201]  77.77,106.12 0 top
R8774  10K  [0201]  77.77,106.73 0 top
R8775  10K  [0201]  77.77,107.34 0 top
R8776  10K  [0201]  77.77,107.95 0 top
R8777  10K  [0201]  77.77,108.56 0 top
R8778  10K  [0201]  77.77,109.17 0 top
R8779  10K  [0201]  77.77,109.78 0 top
R8780  10K  [0201]  77.77,110.39 0 top
R8781  10K  [0201]  77.77,111 0 top
R8782  10K  [0201]  77.77,111.61 0 top
R8783  10K  [0201]  77.77,112.22 0 top
R8784  10K  [0201]  77.77,112.83 0 top
R8785  10K  [0201]  77.77,113.44 0 top
R8786  10K  [0201]  77.77,114.05 0 top
R8787  10K  [0201]  77.77,114.66 0 top
R8788  10K  [0201]  77.77,115.27 0 top
R8789  10K  [0201]  77.77,115.87 0 top
R8790  10K  [0201]  77.77,116.48 0 top
R8791  10K  [0201]  77.77,117.09 0 top
R8792  10K  [0201]  77.77,117.7 0 top
R8793  10K  [0201]  77.77,118.31 0 top
R8794  10K  [0201]  77.77,118.92 0 top
R8795  10K  [0201]  77.77,119.53 0 top
R8796  10K  [0201]  77.77,120.14 0 top
R8797  10K  [0201]  77.77,120.75 0 top
R8798  10K  [0201]  77.77,121.36 0 top
R8799  10K  [0201]  77.77,121.97 0 top
R8800  10K  [0201]  77.77,122.58 0 top
R8801  10K  [0201]  78.99,1.27 0 top
R8802  10K  [0201]  78.99,1.88 0 top
R8803  10K  [0201]  78.99,2.49 0 top
R8804  10K  [0201]  78.99,3.1 0 top
R8805  10K  [0201]  78.99,3.71 0 top
R8806  10K  [0201]  78.99,4.32 0 top
R8807  10K  [0201]  78.99,4.93 0 top
R8808  10K  [0201]  78.99,5.54 0 top
R8809  10K  [0201]  78.99,6.15 0 top
R8810  10K  [0201]  78.99,6.76 0 top
R8811  10K  [0201]  78.99,7.37 0 top
R8812  10K  [0201]  78.99,7.98 0 top
R8813  10K  [0201]  78.99,8.59 0 top
R8814  10K  [0201]  78.99,9.19 0 top
R8815  10K  [0201]  78.99,9.8 0 top
R8816  10K  [0201]  78.99,10.41 0 top
R8817  10K  [0201]  78.99,11.02 0 top
R8818  10K  [0201]  78.99,11.63 0 top
R8819  10K  [0201]  78.99,12.24 0 top
R8820  10K  [0201]  78.99,12.85 0 top
R8821  10K  [0201]  78.99,13.46 0 top
R8822  10K  [0201]  78.99,14.07 0 top
R8823  10K  [0201]  78.99,14.68 0 top
R8824  10K  [0201]  78.99,15.29 0 top
R8825  10K  [0201]  78.99,15.9 0 top
R8826  10K  [0201]  78.99,16.51 0 top
R8827  10K  [0201]  78.99,17.12 0 top
R8828  10K  [0201]  78.99,17.73 0 top
R8829  10K  [0201]  78.99,18.34 0 top
R8830  10K  [0201]  78.99,18.95 0 top
R8831  10K  [0201]  78.99,19.56 0 top
R8832  10K  [0201]  78.99,20.17 0 top
R8833  10K  [0201]  78.99,20.78 0 top
R8834  10K  [0201]  78.99,21.39 0 top
R8835  10K  [0201]  78.99,22 0 top
R8836  10K  [0201]  78.99,22.61 0 top
R8837  10K  [0201]  78.99,23.22 0 top
R8838  10K  [0201]  78.99,23.83 0 top
R8839  10K  [0201]  78.99,24.43 0 top
R8840  10K  [0201]  78.99,25.04 0 top
R8841  10K  [0201]  78.99,25.65 0 top
R8842  10K  [0201]  78.99,26.26 0 top
R8843  10K  [0201]  78.99,26.87 0 top
R8844  10K  [0201]  78.99,27.48 0 top
R8845  10K  [0201]  78.99,28.09 0 top
R8846  10K  [0201]  78.99,28.7 0 top
R8847  10K  [0201]  78.99,29.31 0 top
R8848  10K  [0201]  78.99,29.92 0 top
R8849  10K  [0201]  78.99,30.53 0 top
R8850  10K  [0201]  78.99,31.14 0 top
R8851  10K  [0201]  78.99,31.75 0 top
R8852  10K  [0201]  78.99,32.36 0 top
R8853  10K  [0201]  78.99,32.97 0 top
R8854  10K  [0201]  78.99,33.58 0 top
R8855  10K  [0201]  78.99,34.19 0 top
R8856  10K  [0201]  78.99,34.8 0 top
R8857  10K  [0201]  78.99,35.41 0 top
R8858  10K  [0201]  78.99,36.02 0 top
R8859  10K  [0201]  78.99,36.63 0 top
R8860  10K  [0201]  78.99,37.24 0 top
R8861  10K  [0201]  78.99,37.85 0 top
R8862  10K  [0201]  78.99,38.46 0 top
R8863  10K  [0201]  78.99,39.07 0 top
R8864  10K  [0201]  78.99,39.67 0 top
R8865  10K  [0201]  78.99,40.28 0 top
R8866  10K  [0201]  78.99,40.89 0 top
R8867  10K  [0201]  78.99,41.5 0 top
R8868  10K  [0201]  78.99,42.11 0 top
R8869  10K  [0201]  78.99,42.72 0 top
R8870  10K  [0201]  78.99,43.33 0 top
R8871  10K  [0201]  78.99,43.94 0 top
R8872  10K  [0201]  78.99,44.55 0 top
R8873  10K  [0201]  78.99,45.16 0 top
R8874  10K  [0201]  78.99,45.77 0 top
R8875  10K  [0201]  78.99,46.38 0 top
R8876  10K  [0201]  78.99,46.99 0 top
R8877  10K  [0201]  78.99,47.6 0 top
R8878  10K  [0201]  78.99,48.21 0 top
R8879  10K  [0201]  78.99,48.82 0 top
R8880  10K  [0201]  78.99,49.43 0 top
R8881  10K  [0201]  78.99,50.04 0 top
R8882  10K  [0201]  78.99,50.65 0 top
R8883  10K  [0201]  78.99,51.26 0 top
R8884  10K  [0201]  78.99,51.87 0 top
R8885  10K  [0201]  78.99,52.48 0 top
R8886  10K  [0201]  78.99,53.09 0 top
R8887  10K  [0201]  78.99,53.7 0 top
R8888  10K  [0201]  78.99,54.31 0 top
R8889  10K  [0201]  78.99,54.91 0 top
R8890  10K  [0201]  78.99,55.52 0 top
R8891  10K  [0201]  78.99,56.13 0 top
R8892  10K  [0201]  78.99,56.74 0 top
R8893  10K  [0201]  78.99,57.35 0 top
R8894  10K  [0201]  78.99,57.96 0 top
R8895  10K  [0201]  78.99,58.57 0 top
R8896  10K  [0201]  78.99,59.18 0 top
R8897  10K  [0201]  78.99,59.79 0 top
R8898  10K  [0201]  78.99,60.4 0 top
R8899  10K  [0201]  78.99,61.01 0 top
R8900  10K  [0201]  78.99,61.62 0 top
R8901  10K  [0201]  78.99,62.23 0 top
R8902  10K  [0201]  78.99,62.84 0 top
R8903  10K  [0201]  78.99,63.45 0 top
R8904  10K  [0201]  78.99,64.06 0 top
R8905  10K  [0201]  78.99,64.67 0 top
R8906  10K  [0201]  78.99,65.28 0 top
R8907  10K  [0201]  78.99,65.89 0 top
R8908  10K  [0201]  78.99,66.5 0 top
R8909  10K  [0201]  78.99,67.11 0 top
R8910  10K  [0201]  78.99,67.72 0 top
R8911  10K  [0201]  78.99,68.33 0 top
R8912  10K  [0201]  78.99,68.94 0 top
R8913  10K  [0201]  78.99,69.55 0 top
R8914  10K  [0201]  78.99,70.15 0 top
R8915  10K  [0201]  78.99,70.76 0 top
R8916  10K  [0201]  78.99,71.37 0 top
R8917  10K  [0201]  78.99,71.98 0 top
R8918  10K  [0201]  78.99,72.59 0 top
R8919  10K  [0201]  78.99,73.2 0 top
R8920  10K  [0201]  78.99,73.81 0 top
R8921  10K  [0201]  78.99,74.42 0 top
R8922  10K  [0201]  78.99,75.03 0 top
R8923  10K  [0201]  78.99,75.64 0 top
R8924  10K  [0201]  78.99,76.25 0 top
R8925  10K  [0201]  78.99,76.86 0 top
R8926  10K  [0201]  78.99,77.47 0 top
R8927  10K  [0201]  78.99,78.08 0 top
R8928  10K  [0201]  78.99,78.69 0 top
R8929  10K  [0201]  78.99,79.3 0 top
R8930  10K  [0201]  78.99,79.91 0 top
R8931  10K  [0201]  78.99,80.52 0 top
R8932  10K  [0201]  78.99,81.13 0 top
R8933  10K  [0201]  78.99,81.74 0 top
R8934  10K  [0201]  78.99,82.35 0 top
R8935  10K  [0201]  78.99,82.96 0 top
R8936  10K  [0201]  78.99,83.57 0 top
R8937  10K  [0201]  78.99,84.18 0 top
R8938  10K  [0201]  78.99,84.79 0 top
R8939  10K  [0201]  78.99,85.39 0 top
R8940  10K  [0201]  78.99,86 0 top
R8941  10K  [0201]  78.99,86.61 0 top
R8942  10K  [0201]  78.99,87.22 0 top
R8943  10K  [0201]  78.99,87.83 0 top
R8944  10K  [0201]  78.99,88.44 0 top
R8945  10K  [0201]  78.99,89.05 0 top
R8946  10K  [0201]  78.99,89.66 0 top
R8947  10K  [0201]  78.99,90.27 0 top
R8948  10K  [0201]  78.99,90.88 0 top
R8949  10K  [0201]  78.99,91.49 0 top
R8950  10K  [0201]  78.99,92.1 0 top
R8951  10K  [0201]  78.99,92.71 0 top
R8952  10K  [0201]  78.99,93.32 0 top
R8953  10K  [0201]  78.99,93.93 0 top
R8954  10K  [0201]  78.99,94.54 0 top
R8955  10K  [0201]  78.99,95.15 0 top
R8956  10K  [0201]  78.99,95.76 0 top
R8957  10K  [0201]  78.99,96.37 0 top
R8958  10K  [0201]  78.99,96.98 0 top
R8959  10K  [0201]  78.99,97.59 0 top
R8960  10K  [0201]  78.99,98.2 0 top
R8961  10K  [0201]  78.99,98.81 0 top
R8962  10K  [0201]  78.99,99.42 0 top
R8963  10K  [0201]  78.99,100.03 0 top
R8964  10K  [0201]  78.99,100.63 0 top
R8965  10K  [0201]  78.99,101.24 0 top
R8966  10K  [0201]  78.99,101.85 0 top
R8967  10K  [0201]  78.99,102.46 0 top
R8968  10K  [0201]  78.99,103.07 0 top
R8969  10K  [0201]  78.99,103.68 0 top
R8970  10K  [0201]  78.99,104.29 0 top
R8971  10K  [0201]  78.99,104.9 0 top
R8972  10K  [0201]  78.99,105.51 0 top
R8973  10K  [0201]  78.99,106.12 0 top
R8974  10K  [0201]  78.99,106.73 0 top
R8975  10K  [0201]  78.99,107.34 0 top
R8976  10K  [0201]  78.99,107.95 0 top
R8977  10K  [0201]  78.99,108.56 0 top
R8978  10K  [0201]  78.99,109.17 0 top
R8979  10K  [0201]  78.99,109.78 0 top
R8980  10K  [0201]  78.99,110.39 0 top
R8981  10K  [0201]  78.99,111 0 top
R8982  10K  [0201]  78.99,111.61 0 top
R8983  10K  [0201]  78.99,112.22 0 top
R8984  10K  [0201]  78.99,112.83 0 top
R8985  10K  [0201]  78.99,113.44 0 top
R8986  10K  [0201]  78.99,114.05 0 top
R8987  10K  [0201]  78.99,114.66 0 top
R8988  10K  [0201]  78.99,115.27 0 top
R8989  10K  [0201]  78.99,115.87 0 top
R8990  10K  [0201]  78.99,116.48 0 top
R8991  10K  [0201]  78.99,117.09 0 top
R8992  10K  [0201]  78.99,117.7 0 top
R8993  10K  [0201]  78.99,118.31 0 top
R8994  10K  [0201]  78.99,118.92 0 top
R8995  10K  [0201]  78.99,119.53 0 top
R8996  10K  [0201]  78.99,120.14 0 top
R8997  10K  [0201]  78.99,120.75 0 top
R8998  10K  [0201]  78.99,121.36 0 top
R8999  10K  [0201]  78.99,121.97 0 top
R9000  10K  [0201]  78.99,122.58 0 top
R9001  10K  [0201]  80.21,1.27 0 top
R9002  10K  [0201]  80.21,1.88 0 top
R9003  10K  [0201]  80.21,2.49 0 top
R9004  10K  [0201]  80.21,3.1 0 top
R9005  10K  [0201]  80.21,3.71 0 top
R9006  10K  [0201]  80.21,4.32 0 top
R9007  10K  [0201]  80.21,4.93 0 top
R9008  10K  [0201]  80.21,5.54 0 top
R9009  10K  [0201]  80.21,6.15 0 top
R9010  10K  [0201]  80.21,6.76 0 top
R9011  10K  [0201]  80.21,7.37 0 top
R9012  10K  [0201]  80.21,7.98 0 top
R9013  10K  [0201]  80.21,8.59 0 top
R9014  10K  [0201]  80.21,9.19 0 top
R9015  10K  [0201]  80.21,9.8 0 top
R9016  10K  [0201]  80.21,10.41 0 top
R9017  10K  [0201]  80.21,11.02 0 top
R9018  10K  [0201]  80.21,11.63 0 top
R9019  10K  [0201]  80.21,12.24 0 top
R9020  10K  [0201]  80.21,12.85 0 top
R9021  10K  [0201]  80.21,13.46 0 top
R9022  10K  [0201]  80.21,14.07 0 top
R9023  10K  [0201]  80.21,14.68 0 top
R9024  10K  [0201]  80.21,15.29 0 top
R9025  10K  [0201]  80.21,15.9 0 top
R9026  10K  [0201]  80.21,16.51 0 top
R9027  10K  [0201]  80.21,17.12 0 top
R9028  10K  [0201]  80.21,17.73 0 top
R9029  10K  [0201]  80.21,18.34 0 top
R9030  10K  [0201]  80.21,18.95 0 top
R9031  10K  [0201]  80.21,19.56 0 top
R9032  10K  [0201]  80.21,20.17 0 top
R9033  10K  [0201]  80.21,20.78 0 top
R9034  10K  [0201]  80.21,21.39 0 top
R9035  10K  [0201]  80.21,22 0 top
R9036  10K  [0201]  80.21,22.61 0 top
R9037  10K  [0201]  80.21,23.22 0 top
R9038  10K  [0201]  80.21,23.83 0 top
R9039  10K  [0201]  80.21,24.43 0 top
R9040  10K  [0201]  80.21,25.04 0 top
R9041  10K  [0201]  80.21,25.65 0 top
R9042  10K  [0201]  80.21,26.26 0 top
R9043  10K  [0201]  80.21,26.87 0 top
R9044  10K  [0201]  80.21,27.48 0 top
R9045  10K  [0201]  80.21,28.09 0 top
R9046  10K  [0201]  80.21,28.7 0 top
R9047  10K  [0201]  80.21,29.31 0 top
R9048  10K  [0201]  80.21,29.92 0 top
R9049  10K  [0201]  80.21,30.53 0 top
R9050  10K  [0201]  80.21,31.14 0 top
R9051  10K  [0201]  80.21,31.75 0 top
R9052  10K  [0201]  80.21,32.36 0 top
R9053  10K  [0201]  80.21,32.97 0 top
R9054  10K  [0201]  80.21,33.58 0 top
R9055  10K  [0201]  80.21,34.19 0 top
R9056  10K  [0201]  80.21,34.8 0 top
R9057  10K  [0201]  80.21,35.41 0 top
R9058  10K  [0201]  80.21,36.02 0 top
R9059  10K  [0201]  80.21,36.63 0 top
R9060  10K  [0201]  80.21,37.24 0 top
R9061  10K  [0201]  80.21,37.85 0 top
R9062  10K  [0201]  80.21,38.46 0 top
R9063  10K  [0201]  80.21,39.07 0 top
R9064  10K  [0201]  80.21,39.67 0 top
R9065  10K  [0201]  80.21,40.28 0 top
R9066  10K  [0201]  80.21,40.89 0 top
R9067  10K  [0201]  80.21,41.5 0 top
R9068  10K  [0201]  80.21,42.11 0 top
R9069  10K  [0201]  80.21,42.72 0 top
R9070  10K  [0201]  80.21,43.33 0 top
R9071  10K  [0201]  80.21,43.94 0 top
R9072  10K  [0201]  80.21,44.55 0 top
R9073  10K  [0201]  80.21,45.16 0 top
R9074  10K  [0201]  80.21,45.77 0 top
R9075  10K  [0201]  80.21,46.38 0 top
R9076  10K  [0201]  80.21,46.99 0 top
R9077  10K  [0201]  80.21,47.6 0 top
R9078  10K  [0201]  80.21,48.21 0 top
R9079  10K  [0201]  80.21,48.82 0 top
R9080  10K  [0201]  80.21,49.43 0 top
R9081  10K  [0201]  80.21,50.04 0 top
R9082  10K  [0201]  80.21,50.65 0 top
R9083  10K  [0201]  80.21,51.26 0 top
R9084  10K  [0201]  80.21,51.87 0 top
R9085  10K  [0201]  80.21,52.48 0 top
R9086  10K  [0201]  80.21,53.09 0 top
R9087  10K  [0201]  80.21,53.7 0 top
R9088  10K  [0201]  80.21,54.31 0 top
R9089  10K  [0201]  80.21,54.91 0 top
R9090  10K  [0201]  80.21,55.52 0 top
R9091  10K  [0201]  80.21,56.13 0 top
R9092  10K  [0201]  80.21,56.74 0 top
R9093  10K  [0201]  80.21,57.35 0 top
R9094  10K  [0201]  80.21,57.96 0 top
R9095  10K  [0201]  80.21,58.57 0 top
R9096  10K  [0201]  80.21,59.18 0 top
R9097  10K  [0201]  80.21,59.79 0 top
R9098  10K  [0201]  80.21,60.4 0 top
R9099  10K  [0201]  80.21,61.01 0 top
R9100  10K  [0201]  80.21,61.62 0 top
R9101  10K  [0201]  80.21,62.23 0 top
R9102  10K  [0201]  80.21,62.84 0 top
R9103  10K  [0201]  80.21,63.45 0 top
R9104  10K  [0201]  80.21,64.06 0 top
R9105  10K  [0201]  80.21,64.67 0 top
R9106  10K  [0201]  80.21,65.28 0 top
R9107  10K  [0201]  80.21,65.89 0 top
R9108  10K  [0201]  80.21,66.5 0 top
R9109  10K  [0201]  80.21,67.11 0 top
R9110  10K  [0201]  80.21,67.72 0 top
R9111  10K  [0201]  80.21,68.33 0 top
R9112  10K  [0201]  80.21,68.94 0 top
R9113  10K  [0201]  80.21,69.55 0 top
R9114  10K  [0201]  80.21,70.15 0 top
R9115  10K  [0201]  80.21,70.76 0 top
R9116  10K  [0201]  80.21,71.37 0 top
R9117  10K  [0201]  80.21,71.98 0 top
R9118  10K  [0201]  80.21,72.59 0 top
R9119  10K  [0201]  80.21,73.2 0 top
R9120  10K  [0201]  80.21,73.81 0 top
R9121  10K  [0201]  80.21,74.42 0 top
R9122  10K  [0201]  80.21,75.03 0 top
R9123  10K  [0201]  80.21,75.64 0 top
R9124  10K  [0201]  80.21,76.25 0 top
R9125  10K  [0201]  80.21,76.86 0 top
R9126  10K  [0201]  80.21,77.47 0 top
R9127  10K  [0201]  80.21,78.08 0 top
R9128  10K  [0201]  80.21,78.69 0 top
R9129  10K  [0201]  80.21,79.3 0 top
R9130  10K  [0201]  80.21,79.91 0 top
R9131  10K  [0201]  80.21,80.52 0 top
R9132  10K  [0201]  80.21,81.13 0 top
R9133  10K  [0201]  80.21,81.74 0 top
R9134  10K  [0201]  80.21,82.35 0 top
R9135  10K  [0201]  80.21,82.96 0 top
R9136  10K  [0201]  80.21,83.57 0 top
R9137  10K  [0201]  80.21,84.18 0 top
R9138  10K  [0201]  80.21,84.79 0 top
R9139  10K  [0201]  80.21,85.39 0 top
R9140  10K  [0201]  80.21,86 0 top
R9141  10K  [0201]  80.21,86.61 0 top
R9142  10K  [0201]  80.21,87.22 0 top
R9143  10K  [0201]  80.21,87.83 0 top
R9144  10K  [0201]  80.21,88.44 0 top
R9145  10K  [0201]  80.21,89.05 0 top
R9146  10K  [0201]  80.21,89.66 0 top
R9147  10K  [0201]  80.21,90.27 0 top
R9148  10K  [0201]  80.21,90.88 0 top
R9149  10K  [0201]  80.21,91.49 0 top
R9150  10K  [0201]  80.21,92.1 0 top
R9151  10K  [0201]  80.21,92.71 0 top
R9152  10K  [0201]  80.21,93.32 0 top
R9153  10K  [0201]  80.21,93.93 0 top
R9154  10K  [0201]  80.21,94.54 0 top
R9155  10K  [0201]  80.21,95.15 0 top
R9156  10K  [0201]  80.21,95.76 0 top
R9157  10K  [0201]  80.21,96.37 0 top
R9158  10K  [0201]  80.21,96.98 0 top
R9159  10K  [0201]  80.21,97.59 0 top
R9160  10K  [0201]  80.21,98.2 0 top
R9161  10K  [0201]  80.21,98.81 0 top
R9162  10K  [0201]  80.21,99.42 0 top
R9163  10K  [0201]  80.21,100.03 0 top
R9164  10K  [0201]  80.21,100.63 0 top
R9165  10K  [0201]  80.21,101.24 0 top
R9166  10K  [0201]  80.21,101.85 0 top
R9167  10K  [0201]  80.21,102.46 0 top
R9168  10K  [0201]  80.21,103.07 0 top
R9169  10K  [0201]  80.21,103.68 0 top
R9170  10K  [0201]  80.21,104.29 0 top
R9171  10K  [0201]  80.21,104.9 0 top
R9172  10K  [0201]  80.21,105.51 0 top
R9173  10K  [0201]  80.21,106.12 0 top
R9174  10K  [0201]  80.21,106.73 0 top
R9175  10K  [0201]  80.21,107.34 0 top
R9176  10K  [0201]  80.21,107.95 0 top
R9177  10K  [0201]  80.21,108.56 0 top